# EasyEDA Pro project Chessboards.epro, board Diagonal (continued)
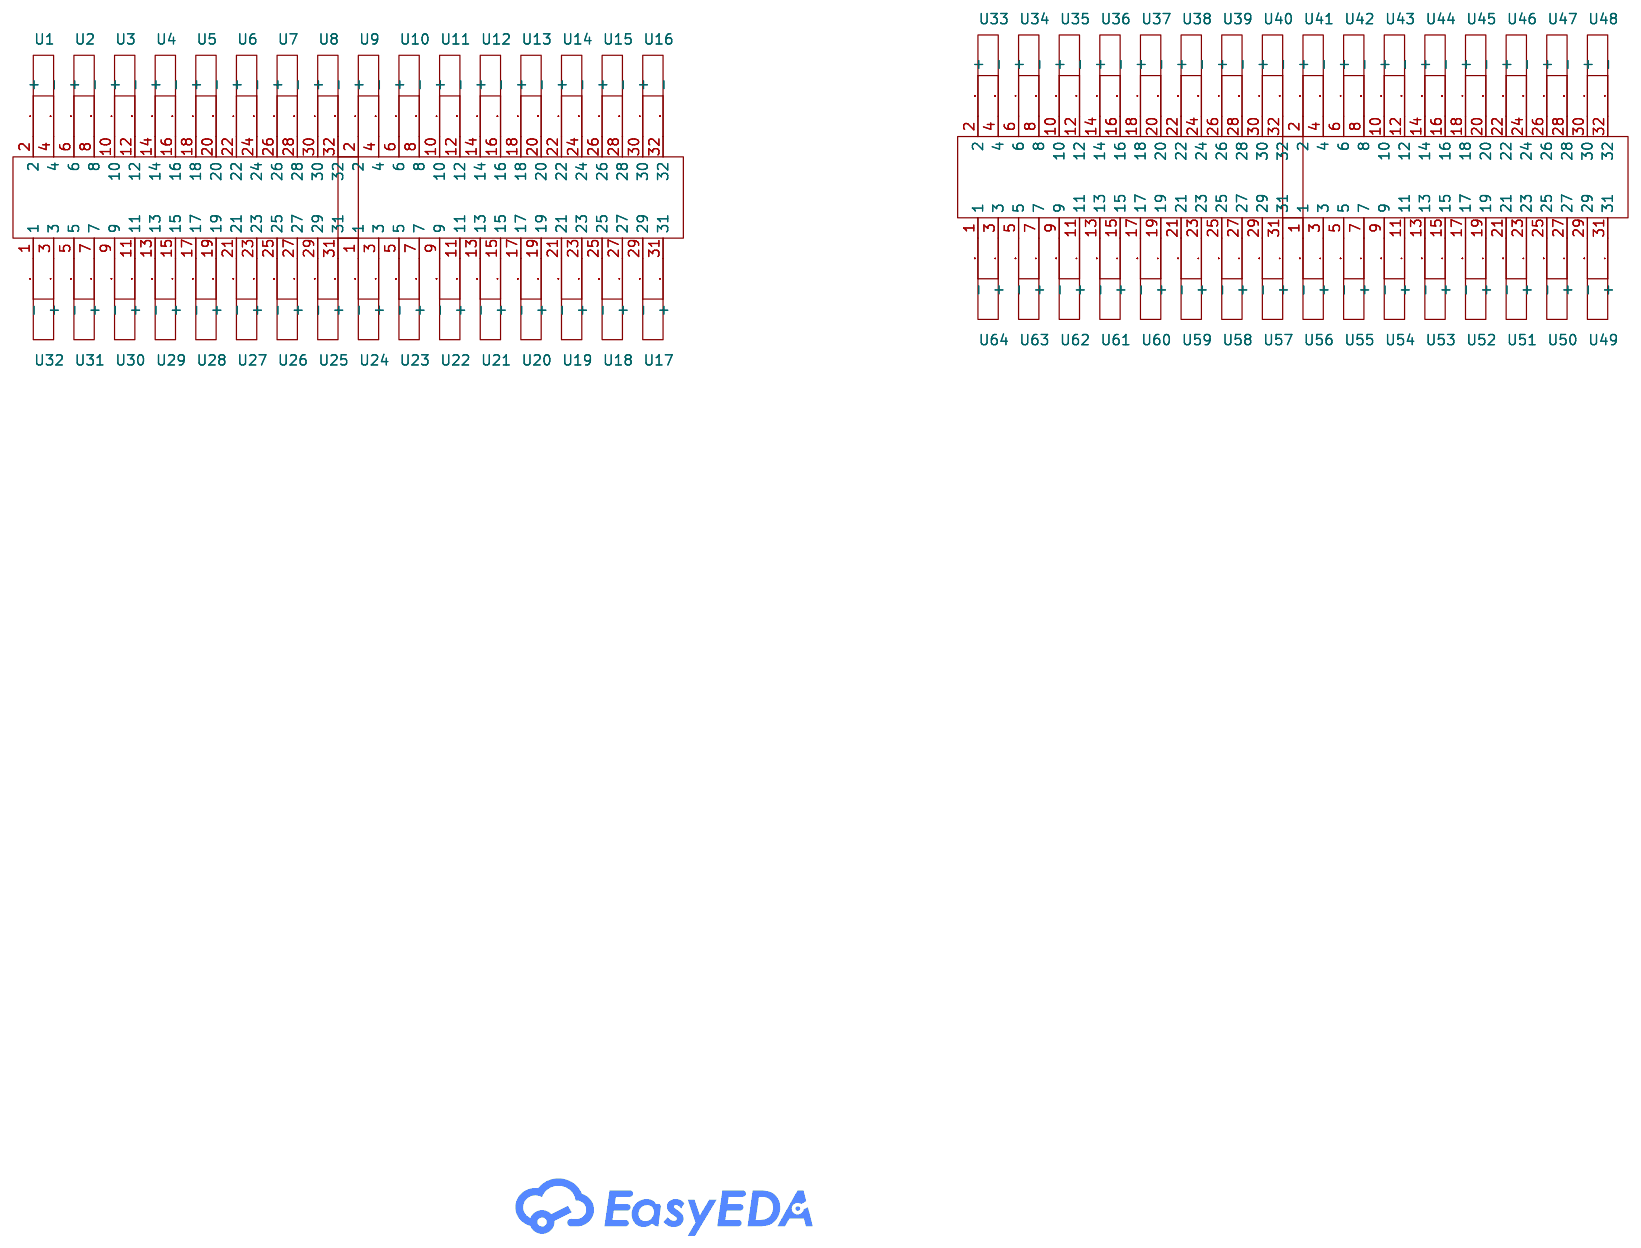
[diagram p0: schematic sheet]
## Routing (per net, layer and track width the routed paths; a pad name or vN(x,y) marks a point on that pad's centre or on a via; arc(x,y) is an arc through that point) (continued)
432.98,63.71 426.32,57.05 ; 184.44,407.04 184.44,406.54 179.61,401.71 179.61,399.5 176.3,396.19 166.32,396.19 153.44,409.08 153.44,428.48 165.21,440.26 165.21,440.51 158.45,447.27 158.45,476.37 ; 69.89,54.5 69.89,41.16 76.08,34.97 78.4,34.97 78.79,34.58 78.79,33.51 72.82,27.55 v2(72.82,3.72) ; v2(225.51,476.35) 225.51,445.34 225.97,444.88 225.97,437.42 224.33,435.78 204.25,435.78 199.79,431.32 ; 329.09,53.21 329.09,53.72 327.48,55.33 327.48,60.02 323.57,63.93 317.87,63.93 307.85,53.91 ; 472.25,476.39 472.25,445.38 465.37,438.5 465.37,436.29 462.06,432.98 441.98,432.98 439.19,430.19 ; 139.03,407.04 139.03,406.54 138.07,405.57 138.07,400.38 136.01,398.33 124.3,398.33 120.56,402.07 120.56,431.5 ; 85.56,53.21 85.56,53.72 88.46,56.61 88.46,58.99 86.01,61.44 82.38,61.44 73.82,52.88 ; 151.95,53.17 160.93,62.15 165.15,62.15 168.02,59.28 168.02,55.33 166.41,53.72 166.41,53.21 ; 386.32,54.06 396.55,64.29 402.54,64.29 406.66,60.17 406.66,55.97 408.92,53.72 U6.56 ; U1.56 291.72,406.51 293.97,404.26 293.97,401.09 292.96,400.08 282.72,400.08 280.02,402.78 280.02,430.74 ; 276.83,432.06 282.33,437.56 302.41,437.56 303,438.16 303,440.29 297.95,445.34 297.95,476.35 ; 179.44,407.04 179.44,406.54 177.83,404.93 177.83,400.24 175.56,397.97 167.06,397.97 155.22,409.82 155.22,427.74 167.12,439.64 167.12,444.97 164.82,447.27 164.82,476.37 ; U6.68 438.33,53.72 442.51,57.9 442.51,58.69 442.12,59.08 434.9,59.08 430.95,55.13 ; 295.41,476.35 295.41,445.34 302.29,438.46 302.11,438.28 282.04,438.28 276.12,432.36 ; 164.41,53.21 164.41,53.72 167.31,56.61 167.31,58.99 164.85,61.44 161.22,61.44 152.66,52.88 ; 454.41,476.39 454.41,445.38 460.38,439.42 460.38,438.35 459.99,437.96 439.92,437.96 434.21,432.25 ; v2(380.19,3.71) 380.19,27.47 376.97,30.68 376.97,35.98 374.5,38.45 354.79,38.45 351.04,42.2 351.04,55.58 ; 105.62,407.02 105.62,406.51 100.79,401.68 100.79,399.47 97.49,396.16 87.51,396.16 74.62,409.05 74.62,428.45 86.39,440.23 86.39,440.48 79.64,447.24 v2(79.64,476.35) ; 244.52,3.69 244.52,27.52 240.39,31.65 240.39,36.17 237.71,38.86 235.39,38.86 231.49,42.76 231.49,52.85 ; 74.53,52.58 82.67,60.73 85.72,60.73 87.75,58.69 87.75,57.9 83.56,53.72 83.56,53.21 ; 461.58,3.71 461.58,27.47 456.53,32.52 456.53,36.27 453.64,39.16 433.93,39.16 430.6,42.5 430.6,55.28 ; 342.12,407.02 342.12,406.51 337.29,401.68 337.29,399.47 333.99,396.16 324.01,396.16 311.12,409.05 311.12,428.45 322.89,440.23 322.89,440.48 316.13,447.24 316.13,476.35 ; v2(61.01,3.71) 61.01,27.47 60.55,27.93 60.55,35.54 58.7,37.38 39,37.38 34.62,41.76 34.62,56.02 ; 150.16,53.91 150.16,41.75 155.52,36.39 157.83,36.39 159.06,35.17 159.06,29.84 156.76,27.55 156.76,3.72 ; 118.42,432.38 118.42,401.18 123.41,396.19 136.89,396.19 140.2,399.5 140.2,401.71 145.03,406.54 145.03,407.04 ; U5.66 381.61,406.56 376.78,401.73 376.78,399.52 373.47,396.21 359.99,396.21 355,401.2 355,432.4 ; 218.69,3.69 218.69,27.44 218.24,27.9 218.24,35.51 216.39,37.36 196.68,37.36 192.3,41.73 192.3,55.99 ; 291.17,3.71 291.17,27.47 295.3,31.6 295.3,34.8 294.49,35.6 274.79,35.6 269.37,41.02 269.37,56.76 ; 190.87,56.58 196.91,62.62 207.08,62.62 209.56,60.14 209.56,55.94 211.81,53.69 211.81,53.19 ; 390.24,52.44 398.17,60.37 400.92,60.37 402.62,58.67 402.62,58.42 397.92,53.72 U6.34 ; v2(241.14,476.35) 241.14,447.24 245.27,443.11 245.27,439.91 233.37,428.01 233.37,409.5 245.63,397.23 254.73,397.23 257.41,399.91 257.41,403.62 260.31,406.51 U1.72 ; 355.37,432.26 361.08,437.97 381.15,437.97 381.54,438.35 381.54,439.42 375.58,445.39 375.58,476.4 ; 153.72,52.44 153.72,43.22 156.99,39.95 159.31,39.95 162.62,36.64 162.62,34.43 169.5,27.55 169.5,3.72 ; U1.68 262.31,406.51 258.12,402.33 258.12,399.62 255.02,396.52 245.34,396.52 232.66,409.2 232.66,428.31 244.56,440.21 244.56,441.27 238.59,447.24 v2(238.59,476.35) ; 214.81,53.19 214.81,53.69 210.63,57.88 210.63,60.58 207.53,63.68 196.47,63.68 189.81,57.03 ; v2(53.37,3.71) 53.37,27.47 58.42,32.52 58.42,34.65 57.82,35.25 38.11,35.25 32.49,40.88 32.49,56.9 ; 130.97,53.21 130.97,53.72 130.01,54.68 130.01,59.87 127.95,61.93 118.36,61.93 112.75,56.31 ; 388.8,53.03 388.8,42.63 392.91,38.53 395.23,38.53 397.7,36.05 397.7,30.76 400.92,27.55 v2(400.92,3.72) ; 111.33,56.9 111.33,40.88 116.96,35.25 136.66,35.25 137.26,34.65 137.26,32.52 132.21,27.47 132.21,3.71 ; 388.81,53.03 397.58,61.8 401.51,61.8 404.17,59.14 404.17,55.97 401.92,53.72 U6.42 ; 36.04,55.43 40.4,59.79 48.22,59.79 49.03,58.99 49.03,56.61 46.13,53.72 v1(46.13,53.21) ; 93.56,53.21 93.56,53.72 91.31,55.97 91.31,60.17 87.19,64.29 81.2,64.29 70.97,54.06 ; v2(378.91,3.71) 378.91,27.47 376.62,29.77 376.62,35.83 374.35,38.1 354.65,38.1 350.69,42.06 350.69,55.72 ; 146.22,3.71 146.22,27.47 141.18,32.52 141.18,36.27 138.28,39.16 118.58,39.16 115.24,42.5 115.24,55.28 ; v2(376.37,3.71) 376.37,27.47 375.91,27.93 375.91,35.54 374.06,37.38 354.35,37.38 349.98,41.76 349.98,56.02 ; 428.46,56.17 428.46,41.61 433.05,37.03 452.75,37.03 454.39,35.39 454.39,27.93 453.93,27.47 453.93,3.71 ; 150.88,53.62 160.48,63.22 165.59,63.22 169.09,59.73 169.09,54.04 169.41,53.72 169.41,53.21 ; 435.98,431.51 435.98,402.08 439.72,398.34 451.43,398.34 453.49,400.4 453.49,405.59 454.45,406.56 454.45,407.06 ; 194.79,54.96 198.53,58.7 205.46,58.7 205.64,58.52 200.81,53.69 v1(200.81,53.21) 200.81,53.19 ; 352.47,54.99 352.47,42.79 355.38,39.88 375.09,39.88 378.4,36.57 378.4,34.36 385.28,27.47 v2(385.28,3.71) ; 230.42,53.3 230.42,42.31 234.94,37.79 237.26,37.79 239.32,35.73 239.32,28.9 240.7,27.52 240.7,3.69 ; 110.62,57.2 110.62,40.58 116.66,34.54 136.37,34.54 136.42,34.48 136.42,34.23 129.66,27.47 129.66,3.71 ; 144.09,476.38 144.09,445.37 146.39,443.07 146.39,437.75 145.17,436.52 125.09,436.52 120.21,431.65 ; 151.23,53.47 151.23,42.19 155.96,37.46 158.28,37.46 160.12,35.61 160.12,28 160.58,27.55 160.58,3.72 ; 359.27,430.63 359.27,402.97 361.76,400.48 371.7,400.48 372.51,401.29 372.51,403.66 369.61,406.56 U5.90 ; U6.46 403.92,53.72 404.88,54.68 404.88,59.43 401.81,62.51 397.29,62.51 388.1,53.32 ; 96.62,407.02 96.62,406.51 97.59,405.55 97.59,400.8 96.16,399.37 88.84,399.37 77.82,410.38 77.82,427.13 89.73,439.03 89.73,445.86 91.1,447.24 v2(91.1,476.35) ; 122.35,430.76 125.98,434.39 146.05,434.39 148.52,436.86 148.52,442.15 151.74,445.37 151.74,476.38 ; 202.64,430.14 205.43,432.94 225.51,432.94 228.81,436.24 228.81,438.46 235.7,445.34 v2(235.7,476.35) ; 92.56,53.21 92.56,53.72 90.95,55.33 90.95,60.02 87.04,63.93 81.34,63.93 71.32,53.91 ; v1(209.9,407.02) 209.9,406.51 214.09,402.33 214.09,401.54 213.7,401.15 204.35,401.15 202.27,403.22 202.27,430.29 ; 119.85,431.79 119.85,401.77 124,397.61 136.3,397.61 138.78,400.09 138.78,404.29 141.03,406.54 141.03,407.04 ; 115.95,54.99 119.69,58.73 126.62,58.73 126.8,58.55 121.97,53.72 121.97,53.21 ; 300.5,476.35 300.5,445.34 303.71,442.13 303.71,437.87 302.7,436.85 282.63,436.85 277.54,431.77 ; 387.39,53.62 396.99,63.22 402.1,63.22 405.6,59.73 405.6,54.04 405.92,53.72 U6.50 ; 271.85,55.72 276.64,60.51 285.04,60.51 286.27,59.28 286.27,55.33 284.66,53.72 U4.76 ; v2(58.91,476.35) 58.91,445.34 65.79,438.46 65.61,438.28 45.54,438.28 39.62,432.36 ; v2(86.84,3.72) 86.84,27.55 82.71,31.68 82.71,36.2 80.02,38.88 77.7,38.88 73.81,42.78 73.81,52.88 ; 39.61,432.36 39.61,401.16 44.6,396.16 58.08,396.16 61.39,399.47 61.39,401.68 66.22,406.51 U2.98 ; 306.78,54.35 317.43,65 324.01,65 328.55,60.46 328.55,57.26 332.09,53.72 332.09,53.21 ; 149.81,54.06 160.04,64.29 166.03,64.29 170.15,60.17 170.15,55.97 172.41,53.72 172.41,53.21 ; 204.81,53.19 204.81,53.69 207.07,55.94 207.07,59.11 206.05,60.12 197.94,60.12 193.37,55.55 ; 308.91,53.47 308.91,42.19 313.64,37.46 315.96,37.46 317.81,35.61 317.81,28 318.27,27.55 318.27,3.72 ; 450.11,3.71 450.11,27.47 453.33,30.68 453.33,34.95 452.31,35.96 432.61,35.96 427.39,41.17 427.39,56.61 ; v2(84.29,3.72) 84.29,27.55 81.99,29.84 81.99,35.91 79.73,38.17 77.41,38.17 73.09,42.49 73.09,53.17 ; 369.48,53.21 369.48,53.72 367.23,55.97 367.23,60.17 364.75,62.64 354.58,62.64 348.55,56.61 ; 121.63,431.06 121.63,402.51 124.74,399.39 135.57,399.39 137,400.82 137,405.57 136.03,406.54 136.03,407.04 ; 231.84,52.71 231.84,42.9 235.53,39.21 237.85,39.21 240.74,36.32 240.74,32.57 245.79,27.52 245.79,3.69 ; 307.5,54.06 317.72,64.29 323.72,64.29 327.84,60.17 327.84,55.97 330.09,53.72 330.09,53.21 ; 356.08,431.96 361.38,437.25 381.45,437.25 382.25,438.06 382.25,441.26 378.12,445.39 378.12,476.4 ; 280.38,430.59 280.38,402.93 282.87,400.44 292.81,400.44 293.61,401.24 293.61,403.62 290.72,406.51 v1(290.72,407.02) ; 270.79,56.17 276.19,61.57 285.49,61.57 287.33,59.73 287.33,54.04 287.66,53.72 U4.82 ; 349.26,56.31 349.26,41.46 354.06,36.67 373.76,36.67 375.19,35.24 375.19,28.85 373.82,27.47 v2(373.82,3.71) ; U1.84 254.31,406.51 255.27,405.55 255.27,400.8 253.84,399.37 246.52,399.37 235.51,410.38 235.51,427.13 247.41,439.03 247.41,445.86 248.78,447.24 v2(248.78,476.35) ; 126.97,53.21 126.97,53.72 128.58,55.33 128.58,59.28 127.36,60.51 118.95,60.51 114.17,55.72 ; 303.05,476.35 303.05,445.34 304.43,443.96 304.43,437.57 303,436.14 282.92,436.14 278.25,431.47 ; U1.36 301.72,406.51 297.53,402.33 297.53,399.62 294.43,396.52 281.24,396.52 276.46,401.3 276.46,432.21 ; 230.08,53.44 239.47,62.84 244.28,62.84 247.57,59.55 247.57,54.01 247.25,53.69 U4.48 247.25,53.19 ; 308.56,53.62 318.17,63.22 323.27,63.22 326.77,59.73 326.77,54.04 327.09,53.72 327.09,53.21 ; 115.24,55.28 119.4,59.44 126.92,59.44 127.51,58.84 127.51,57.26 123.97,53.72 123.97,53.21 ; 326.09,53.21 326.09,53.72 326.41,54.04 326.41,59.58 323.13,62.86 318.31,62.86 308.92,53.47 ; 246.25,53.19 U4.46 246.25,53.69 247.21,54.66 247.21,59.41 244.14,62.48 239.62,62.48 230.43,53.3 ; 32.12,57.05 38.78,63.71 49.84,63.71 52.94,60.61 52.94,57.9 57.13,53.72 U3.30 ; 447.56,3.71 447.56,27.47 452.61,32.52 452.61,34.65 452.02,35.25 432.31,35.25 426.68,40.88 426.68,56.9 ; 322.09,3.72 322.09,27.55 318.88,30.76 318.88,36.05 316.4,38.53 314.08,38.53 309.98,42.63 309.98,53.03 ; 270.08,56.46 270.08,41.32 275.08,36.32 294.79,36.32 296.01,35.09 296.01,29.77 293.72,27.47 293.72,3.71 ; 387.75,53.47 397.14,62.86 401.95,62.86 405.24,59.58 405.24,54.04 404.92,53.72 U6.48 ; 438.84,430.33 441.84,433.33 461.91,433.33 465.01,436.43 465.01,439.42 470.98,445.38 470.98,476.39 ; v2(54.64,3.71) 54.64,27.47 58.77,31.6 58.77,34.8 57.97,35.6 38.26,35.6 32.84,41.02 32.84,56.76 ; 192.66,55.85 192.66,41.88 196.83,37.71 216.53,37.71 218.59,35.66 218.59,28.82 219.97,27.44 219.97,3.69 ; 306.07,54.65 317.13,65.71 324.31,65.71 329.26,60.76 329.26,58.55 334.09,53.72 334.09,53.21 ; 319.54,3.72 319.54,27.55 318.16,28.92 318.16,35.76 316.11,37.81 313.79,37.81 309.26,42.34 309.26,53.32 ; v1(92.62,407.02) 92.62,406.51 96.17,402.97 96.17,401.39 95.57,400.79 89.43,400.79 79.25,410.97 79.25,426.54 91.15,438.44 91.15,442.19 96.2,447.24 v2(96.2,476.35) ; U5.40 418.02,406.56 415.12,403.66 415.12,399.96 412.44,397.28 403.35,397.28 391.08,409.54 391.08,428.06 402.99,439.96 402.99,443.16 398.85,447.29 398.85,476.39 ; 194.8,54.96 194.8,42.77 197.71,39.85 217.42,39.85 220.73,36.54 220.73,34.33 227.61,27.44 227.61,3.69 ; 149.44,54.21 149.44,41.45 155.22,35.68 157.54,35.68 158.34,34.87 158.34,31.68 154.21,27.55 154.21,3.72 ; 131.97,53.21 131.97,53.72 130.36,55.33 130.36,60.02 128.1,62.29 118.22,62.29 112.39,56.46 ; 397.58,476.39 397.58,447.29 402.63,442.24 402.63,440.11 390.73,428.21 390.73,409.39 403.2,396.92 412.59,396.92 415.48,399.81 415.48,403.02 419.02,406.56 U5.38 ; 328.88,476.35 328.88,447.24 326.58,444.95 326.58,438.88 314.68,426.98 314.68,410.53 325.48,399.72 332.51,399.72 333.73,400.95 333.73,404.9 332.12,406.51 332.12,407.02 ; 72.75,53.32 81.94,62.51 86.45,62.51 89.53,59.43 89.53,54.68 88.56,53.72 88.56,53.21 ; 221.24,3.69 221.24,27.44 218.95,29.74 218.95,35.8 216.68,38.07 196.98,38.07 193.02,42.03 193.02,55.7 ; 198.36,431.91 198.36,401.6 202.72,397.23 215.32,397.23 218,399.91 218,403.62 220.9,406.51 U1.104 ; 74.88,52.44 82.82,60.37 85.57,60.37 87.27,58.67 87.27,58.42 82.56,53.72 82.56,53.21 ; 430.59,55.28 434.75,59.44 442.27,59.44 442.87,58.84 442.87,57.26 439.33,53.72 U6.70 ; U1.116 214.9,406.51 215.87,405.55 215.87,400.8 214.43,399.37 203.61,399.37 200.49,402.48 200.49,431.03 ; U6.38 399.92,53.72 403.46,57.26 403.46,58.84 401.22,61.08 397.88,61.08 389.53,52.73 ; U5.62 407.02,406.56 411.21,402.37 411.21,401.58 410.82,401.19 404.97,401.19 395,411.16 395,426.44 406.9,438.34 406.9,441.32 412.87,447.29 412.87,476.39 ; 194.08,55.26 198.23,59.41 205.76,59.41 206.35,58.82 206.35,57.23 202.81,53.69 v1(202.81,53.21) 202.81,53.19 ; U5.92 368.61,406.56 372.15,403.02 372.15,401.43 371.56,400.84 361.91,400.84 359.63,403.12 359.63,430.49 ; 97.56,53.21 97.56,53.72 92.73,58.55 92.73,60.76 87.78,65.71 80.61,65.71 69.54,54.65 ; 339.12,407.02 339.12,406.51 336.23,403.62 336.23,399.91 333.54,397.23 324.45,397.23 312.19,409.5 312.19,428.01 324.09,439.91 324.09,443.11 319.96,447.24 319.96,476.35 ; 335.25,476.35 335.25,447.24 328.36,440.36 328.36,438.14 316.46,426.24 316.46,411.26 326.22,401.5 331.77,401.5 331.95,401.68 327.12,406.51 v1(327.12,407.02) ; v2(228.06,476.35) 228.06,445.34 226.68,443.96 226.68,437.13 224.62,435.07 204.55,435.07 200.5,431.03 ; 317.41,476.35 317.41,447.24 323.38,441.27 323.38,440.21 311.47,428.31 311.47,409.2 324.15,396.52 333.84,396.52 336.94,399.62 336.94,402.33 341.12,406.51 341.12,407.02 ; 240.25,53.19 U4.34 240.25,53.69 244.95,58.39 244.95,58.65 243.25,60.35 240.5,60.35 232.57,52.41 ; U3.20 52.13,53.72 51.16,54.68 51.16,59.87 49.11,61.93 39.52,61.93 33.9,56.31 ; 72.39,53.47 81.79,62.86 86.6,62.86 89.89,59.58 89.89,54.04 89.56,53.72 89.56,53.21 ; 231.78,3.69 231.78,27.52 236.83,32.57 236.83,34.7 236.23,35.3 233.91,35.3 227.93,41.28 227.93,54.33 ; 428.81,56.02 434.01,61.22 443.01,61.22 444.65,59.58 444.65,54.04 444.33,53.72 U6.80 ; 139,476.38 139,445.37 144.96,439.4 144.96,438.33 144.58,437.95 124.5,437.95 118.79,432.24 ; 272.93,55.28 272.93,42.5 276.26,39.16 295.97,39.16 298.86,36.27 298.86,32.52 303.91,27.47 303.91,3.71 ; v1(248.31,407.02) 248.31,406.51 253.14,401.68 252.96,401.5 247.4,401.5 237.64,411.26 237.64,426.24 249.54,438.14 249.54,440.36 256.43,447.24 v2(256.43,476.35) ; U4.72 282.66,53.72 285.55,56.61 285.55,58.99 284.75,59.79 276.93,59.79 272.57,55.43 ; 438.48,430.48 441.69,433.69 461.76,433.69 464.65,436.58 464.65,440.33 469.7,445.38 469.7,476.39 ; U1.114 215.9,406.51 216.22,406.19 216.22,400.65 214.58,399.01 203.46,399.01 200.14,402.34 200.14,431.18 ; 170.41,53.21 170.41,53.72 169.44,54.68 169.44,59.87 165.74,63.58 160.34,63.58 150.52,53.76 ; 159.31,3.72 159.31,27.55 159.77,28 159.77,35.46 158.13,37.1 155.81,37.1 150.87,42.04 150.87,53.62 ; v2(82.18,476.35) 82.18,447.24 87.23,442.19 87.23,440.06 75.33,428.16 75.33,409.35 87.8,396.88 97.19,396.88 100.08,399.77 100.08,402.97 103.62,406.51 103.62,407.02 ; U3.14 49.13,53.72 50.09,54.68 50.09,59.43 48.66,60.86 39.96,60.86 34.97,55.87 ; 172.47,476.37 172.47,447.27 169.25,444.05 169.25,438.76 157.35,426.86 157.35,410.7 167.95,400.11 174.68,400.11 175.69,401.12 175.69,404.29 173.44,406.54 173.44,407.04 ; U6.72 440.33,53.72 443.22,56.61 443.22,58.99 442.42,59.79 434.6,59.79 430.24,55.43 ; 41.39,431.62 41.39,401.89 45.34,397.94 57.34,397.94 59.61,400.21 59.61,404.9 61.22,406.51 U2.108 ; 438.12,430.63 441.54,434.05 461.62,434.05 464.3,436.73 464.3,441.25 468.43,445.38 468.43,476.39 ; 334.12,407.02 334.12,406.51 334.44,406.19 334.44,400.65 332.81,399.01 325.19,399.01 313.97,410.23 313.97,427.27 325.87,439.18 325.87,446.78 326.33,447.24 326.33,476.35 ; 148.74,54.5 159.6,65.36 166.48,65.36 171.22,60.61 171.22,57.9 175.41,53.72 175.41,53.21 ; 384.89,54.65 384.89,41.01 391.29,34.61 393.61,34.61 393.66,34.56 393.66,34.3 386.9,27.55 v2(386.9,3.72) ; 40.32,432.06 40.32,401.45 44.89,396.88 57.78,396.88 60.67,399.77 60.67,402.97 64.22,406.51 U2.102 ; 331.12,407.02 331.12,406.51 333.38,404.26 333.38,401.09 332.36,400.08 325.63,400.08 315.03,410.68 315.03,426.83 326.94,438.73 326.94,444.03 330.15,447.24 330.15,476.35 ; v2(76.64,3.72) 76.64,27.55 79.86,30.76 79.86,35.02 78.84,36.03 76.52,36.03 70.96,41.6 70.96,54.06 ; 307.84,53.91 307.84,41.75 313.2,36.39 315.52,36.39 316.74,35.17 316.74,29.84 314.45,27.55 314.45,3.72 ; 439.18,430.19 439.18,403.41 441.04,401.55 450.1,401.55 450.28,401.73 445.45,406.56 445.45,407.06 ; 426.33,57.05 426.33,40.73 432.16,34.89 451.87,34.89 452.26,34.5 452.26,33.44 446.29,27.47 446.29,3.71 ; 96.56,53.21 96.56,53.72 92.38,57.9 92.38,60.61 87.63,65.36 80.76,65.36 69.9,54.5 ; v1(330.12,407.02) 330.12,406.51 333.02,403.62 333.02,401.24 332.22,400.44 325.78,400.44 315.39,410.82 315.39,426.69 327.29,438.59 327.29,443.11 331.42,447.24 331.42,476.35 ; 268.3,57.2 268.3,40.58 274.35,34.54 294.05,34.54 294.1,34.48 294.1,34.23 287.35,27.47 287.35,3.71 ; 349.62,56.17 349.62,41.61 354.2,37.03 373.91,37.03 375.55,35.39 375.55,27.93 375.09,27.47 v2(375.09,3.71) ; 396.31,476.39 396.31,447.29 402.27,441.32 402.27,440.25 390.37,428.35 390.37,409.25 403.05,396.57 412.74,396.57 415.83,399.66 415.83,402.37 420.02,406.56 U5.36 ; U5.78 375.61,406.56 374.65,405.59 374.65,400.4 372.59,398.35 360.88,398.35 357.14,402.09 357.14,431.52 ; 281.46,430.14 284.25,432.94 304.32,432.94 307.63,436.24 307.63,438.46 314.52,445.34 314.52,476.35 ; 147.91,476.38 147.91,445.37 147.46,444.91 147.46,437.3 145.61,435.45 125.53,435.45 121.28,431.2 ; 113.46,56.02 118.66,61.22 127.65,61.22 129.29,59.58 129.29,54.04 128.97,53.72 128.97,53.21 ; 356.43,431.81 356.43,401.79 360.58,397.63 372.88,397.63 375.36,400.11 375.36,404.31 377.61,406.56 U5.74 ; 386.67,53.91 386.67,41.75 392.03,36.39 394.35,36.39 395.57,35.17 395.57,29.84 393.27,27.55 v2(393.27,3.72) ; 348.91,56.46 348.91,41.32 353.91,36.32 373.62,36.32 374.84,35.09 374.84,29.77 372.54,27.47 v2(372.54,3.71) ; 114.89,55.43 114.89,42.35 118.43,38.81 138.14,38.81 140.82,36.13 140.82,31.6 144.95,27.47 144.95,3.71 ; 255.25,53.19 v1(255.25,53.21) 255.25,53.69 250.42,58.52 250.42,60.73 245.46,65.69 238.29,65.69 227.23,54.62 ; 390.86,476.4 390.86,445.39 385.82,440.34 385.82,436.58 382.92,433.69 362.85,433.69 359.64,430.49 ; 233.05,3.69 233.05,27.52 237.18,31.65 237.18,34.85 236.38,35.65 234.06,35.65 228.28,41.43 228.28,54.18 ; 389.88,52.58 398.03,60.73 401.07,60.73 403.1,58.69 403.1,57.9 398.92,53.72 U6.36 ; 42.82,431.03 46.86,435.07 66.94,435.07 69,437.13 69,443.96 70.37,445.34 v2(70.37,476.35) ; 409.05,476.39 409.05,447.29 405.83,444.07 405.83,438.78 393.93,426.88 393.93,410.72 404.53,400.13 411.26,400.13 412.27,401.14 412.27,404.31 410.02,406.56 U5.56 ; 191.94,56.14 197.35,61.55 206.64,61.55 208.49,59.7 208.49,54.01 208.81,53.69 208.81,53.19 ; 429.17,55.87 434.16,60.86 442.86,60.86 444.29,59.43 444.29,54.68 443.33,53.72 U6.78 ; v2(97.47,476.35) 97.47,447.24 91.51,441.27 91.51,438.29 79.6,426.39 79.6,411.12 89.57,401.15 95.42,401.15 95.81,401.54 95.81,402.33 91.62,406.51 v1(91.62,407.02) ; 44.6,430.29 47.6,433.29 67.68,433.29 70.78,436.39 70.78,439.37 76.74,445.34 v2(76.74,476.35) ; 321.09,53.21 321.09,53.72 324.63,57.26 324.63,58.84 322.39,61.08 319.05,61.08 310.7,52.73 ; v1(51.22,407.02) 51.22,406.51 56.05,401.68 55.87,401.5 46.81,401.5 44.95,403.37 44.95,430.14 ; 70.61,54.21 81.05,64.64 87.34,64.64 91.67,60.32 91.67,56.61 94.56,53.72 94.56,53.21 ; v2(406.01,3.72) 406.01,27.55 399.13,34.43 399.13,36.64 395.82,39.95 393.5,39.95 390.23,43.22 390.23,52.44 ; 197.29,432.36 197.29,401.16 202.28,396.16 215.76,396.16 219.07,399.47 219.07,401.68 223.9,406.51 U1.98 ; 347.48,57.05 347.48,40.73 353.32,34.89 373.03,34.89 373.41,34.5 373.41,33.44 367.45,27.47 v2(367.45,3.71) ; 175.44,407.04 175.44,406.54 176.41,405.57 176.41,400.82 174.98,399.39 167.65,399.39 156.64,410.41 156.64,427.15 168.54,439.06 168.54,445.89 169.92,447.27 169.92,476.37 ; 194.43,55.11 198.38,59.06 205.61,59.06 206,58.67 206,57.88 201.81,53.69 v1(201.81,53.21) 201.81,53.19 ; 379.4,476.4 379.4,445.39 382.61,442.17 382.61,437.91 381.6,436.9 361.52,436.9 356.44,431.81 ; U6.84 446.33,53.72 445.36,54.68 445.36,59.87 443.3,61.93 433.72,61.93 428.1,56.31 ; 280.39,430.59 283.81,434 303.88,434 306.56,436.69 306.56,441.21 310.69,445.34 310.69,476.35 ; v2(399.64,3.72) 399.64,27.55 397.35,29.84 397.35,35.91 395.08,38.17 392.76,38.17 388.45,42.49 388.45,53.17 ; 392.14,476.4 392.14,445.39 386.17,439.42 386.17,436.44 383.07,433.34 363,433.34 360,430.34 ; 321.23,476.35 321.23,447.24 324.44,444.03 324.44,439.77 312.54,427.87 312.54,409.64 324.6,397.59 333.4,397.59 335.87,400.06 335.87,404.26 338.12,406.51 338.12,407.02 ; v2(89.83,476.35) 89.83,447.24 89.37,446.78 89.37,439.18 77.47,427.27 77.47,410.23 88.69,399.01 96.31,399.01 97.95,400.65 97.95,406.19 97.62,406.51 97.62,407.02 ; 165.41,53.21 165.41,53.72 167.66,55.97 167.66,59.14 165,61.8 161.07,61.8 152.3,53.03 ; 112.04,56.61 118.07,62.64 128.24,62.64 130.72,60.17 130.72,55.97 132.97,53.72 132.97,53.21 ; v2(404.74,3.72) 404.74,27.55 398.77,33.51 398.77,36.5 395.67,39.59 393.35,39.59 389.87,43.08 389.87,52.58 ; v1(449.33,53.21) 449.33,53.72 446.43,56.61 446.43,60.32 443.75,63 433.27,63 427.03,56.76 ; 151.58,53.32 151.58,42.34 156.11,37.81 158.42,37.81 160.48,35.76 160.48,28.92 161.86,27.55 161.86,3.72 ; 389.52,52.73 389.52,42.93 393.21,39.24 395.52,39.24 398.42,36.35 398.42,32.59 403.47,27.55 v2(403.47,3.72) ; 309.27,53.32 318.46,62.51 322.98,62.51 326.06,59.43 326.06,54.68 325.09,53.72 325.09,53.21 ; 201.22,430.74 204.84,434.36 224.92,434.36 227.39,436.83 227.39,442.13 230.6,445.34 v2(230.6,476.35) ; v1(412.92,53.21) 412.92,53.72 408.09,58.55 408.09,60.76 403.13,65.71 395.96,65.71 384.9,54.65 ; 387.03,53.76 396.85,63.58 402.25,63.58 405.95,59.87 405.95,54.68 406.92,53.72 U6.52 ; 448.84,3.71 448.84,27.47 452.97,31.6 452.97,34.8 452.16,35.6 432.46,35.6 427.04,41.02 427.04,56.76 ; 318.68,476.35 318.68,447.24 323.73,442.19 323.73,440.06 311.83,428.16 311.83,409.35 324.3,396.88 333.69,396.88 336.58,399.77 336.58,402.97 340.12,406.51 340.12,407.02 ; 327.6,476.35 327.6,447.24 326.22,445.86 326.22,439.03 314.32,427.13 314.32,410.38 325.33,399.37 332.66,399.37 334.09,400.8 334.09,405.55 333.12,406.51 333.12,407.02 ; 39.96,432.21 39.96,401.3 44.75,396.52 57.93,396.52 61.03,399.62 61.03,402.33 65.22,406.51 U2.100 ; 288.62,3.71 288.62,27.47 294.59,33.44 294.59,34.5 294.2,34.89 274.49,34.89 268.66,40.73 268.66,57.05 ; 360.35,430.19 363.15,432.98 383.22,432.98 386.53,436.29 386.53,438.5 393.41,445.39 393.41,476.4 ; 174.41,53.21 174.41,53.72 170.87,57.26 170.87,60.46 166.33,65 159.75,65 149.1,54.35 ; v2(94.92,476.35) 94.92,447.24 90.79,443.11 90.79,438.59 78.89,426.69 78.89,410.82 89.28,400.44 95.72,400.44 96.52,401.24 96.52,403.62 93.62,406.51 v1(93.62,407.02) ; 37.11,54.99 40.85,58.73 47.78,58.73 47.96,58.55 43.13,53.72 v1(43.13,53.21) ; 174.44,407.04 174.44,406.54 176.05,404.93 176.05,400.97 174.83,399.75 167.8,399.75 157,410.55 157,427.01 168.9,438.91 168.9,444.97 171.19,447.27 171.19,476.37 ; 70.25,54.35 70.25,41.31 76.23,35.32 78.55,35.32 79.15,34.73 79.15,32.59 74.1,27.55 v2(74.1,3.72) ; 98.62,407.02 98.62,406.51 98.3,406.19 98.3,400.5 96.45,398.66 88.54,398.66 77.11,410.08 77.11,427.42 89.01,439.32 89.01,446.78 88.55,447.24 v2(88.55,476.35) ; 429.53,55.72 429.53,42.06 433.49,38.1 453.2,38.1 455.46,35.83 455.46,29.77 457.76,27.47 457.76,3.71 ; U2.112 59.22,406.51 58.89,406.19 58.89,400.5 57.05,398.66 45.63,398.66 42.1,402.19 42.1,431.32 ; 280.75,430.44 283.95,433.65 304.03,433.65 306.92,436.54 306.92,440.29 311.97,445.34 311.97,476.35 ; U1.102 221.9,406.51 218.36,402.97 218.36,399.77 215.47,396.88 202.58,396.88 198,401.45 198,432.06 ; v2(62.28,3.71) 62.28,27.47 60.91,28.85 60.91,35.68 58.85,37.74 39.15,37.74 34.98,41.91 34.98,55.87 ; 114.18,55.72 114.18,42.06 118.14,38.1 137.84,38.1 140.11,35.83 140.11,29.77 142.4,27.47 142.4,3.71 ; U5.42 417.02,406.56 414.77,404.31 414.77,400.11 412.29,397.63 403.49,397.63 391.44,409.69 391.44,427.91 403.34,439.81 403.34,444.07 400.13,447.29 400.13,476.39 ; 36.75,55.13 40.7,59.08 47.93,59.08 48.31,58.69 48.31,57.9 44.13,53.72 v1(44.13,53.21) ; 35.33,55.72 35.33,42.06 39.29,38.1 59,38.1 61.26,35.83 61.26,29.77 63.56,27.47 v2(63.56,3.71) ; 135.03,407.04 135.03,406.54 136.64,404.93 136.64,400.97 135.42,399.75 124.89,399.75 121.98,402.66 121.98,430.91 ; 198.01,432.06 203.52,437.56 223.59,437.56 224.19,438.16 224.19,440.29 219.14,445.34 v2(219.14,476.35) ; 232.21,52.56 240.36,60.7 243.4,60.7 245.43,58.67 245.43,57.88 241.25,53.69 U4.36 241.25,53.19 ; U4.84 288.66,53.72 287.69,54.68 287.69,59.87 285.63,61.93 276.05,61.93 270.43,56.31 ; v1(409.92,53.21) 409.92,53.72 407.02,56.61 407.02,60.32 402.69,64.64 396.4,64.64 385.97,54.21 ; U1.54 292.72,406.51 294.33,404.9 294.33,400.95 293.1,399.72 282.57,399.72 279.67,402.63 279.67,430.88 ; U1.82 255.31,406.51 255.63,406.19 255.63,400.65 253.99,399.01 246.37,399.01 235.15,410.23 235.15,427.27 247.05,439.18 247.05,446.78 247.51,447.24 v2(247.51,476.35) ; v2(88.11,3.72) 88.11,27.55 83.06,32.59 83.06,36.35 80.17,39.24 77.85,39.24 74.16,42.93 74.16,52.73 ; 332.7,476.35 332.7,447.24 327.65,442.19 327.65,438.44 315.75,426.54 315.75,410.97 325.92,400.79 332.07,400.79 332.67,401.39 332.67,402.97 329.12,406.51 v1(329.12,407.02) ; 230.51,3.69 230.51,27.52 236.47,33.49 236.47,34.55 236.08,34.94 233.77,34.94 227.57,41.13 227.57,54.48 ; U1.110 217.9,406.51 216.93,405.55 216.93,400.36 214.88,398.3 203.17,398.3 199.43,402.04 199.43,431.47 ; U2.110 60.22,406.51 59.25,405.55 59.25,400.36 57.19,398.3 45.48,398.3 41.74,402.04 41.74,431.47 ; 331.09,53.21 331.09,53.72 328.19,56.61 328.19,60.32 323.86,64.64 317.58,64.64 307.14,54.21 ; 453.45,407.06 453.45,406.56 453.13,406.23 453.13,400.55 451.28,398.7 439.87,398.7 436.33,402.23 436.33,431.37 ; 229,53.89 229,41.72 234.36,36.36 236.67,36.36 237.9,35.14 237.9,29.81 235.6,27.52 235.6,3.69 ; 350.33,55.87 350.33,41.91 354.5,37.74 374.21,37.74 376.26,35.68 376.26,28.85 377.64,27.47 v2(377.64,3.71) ; 111.68,56.76 111.68,41.02 117.1,35.6 136.81,35.6 137.62,34.8 137.62,31.6 133.48,27.47 133.48,3.71 ; 138.03,407.04 138.03,406.54 137.71,406.22 137.71,400.53 135.86,398.68 124.45,398.68 120.91,402.21 120.91,431.35 ; 459.51,476.39 459.51,445.38 461.81,443.09 461.81,437.76 460.58,436.54 440.51,436.54 435.63,431.66 ; 150.39,3.72 150.39,27.55 157.15,34.3 157.15,34.56 157.1,34.61 154.78,34.61 148.38,41.01 148.38,54.65 ; 310.62,3.72 310.62,27.55 315.67,32.59 315.67,34.73 315.08,35.32 312.76,35.32 306.77,41.31 306.77,54.35 ; 352.11,55.13 352.11,42.64 355.24,39.52 374.94,39.52 378.04,36.42 378.04,33.44 384.01,27.47 v2(384.01,3.71) ; 349.97,56.02 355.17,61.22 364.17,61.22 365.8,59.58 365.8,54.04 365.48,53.72 365.48,53.21 ; 451.39,3.71 451.39,27.47 453.68,29.77 453.68,35.09 452.46,36.32 432.75,36.32 427.75,41.32 427.75,56.46 ; U1.112 216.9,406.51 216.58,406.19 216.58,400.5 214.73,398.66 203.31,398.66 199.78,402.19 199.78,431.32 ; 385.61,54.35 396.26,65 402.84,65 407.38,60.46 407.38,57.26 410.92,53.72 v1(410.92,53.21) ; 84.56,53.21 84.56,53.72 88.11,57.26 88.11,58.84 85.86,61.08 82.52,61.08 74.17,52.73 ; 403.95,476.39 403.95,447.29 404.41,446.83 404.41,439.37 392.51,427.47 392.51,410.13 403.94,398.7 411.85,398.7 413.7,400.55 413.7,406.24 414.02,406.56 U5.48